# EasyEDA Pro project 第十五届蓝桥杯EDA赛项模拟试题二（嘉立创EDA提供）.eprj, board PCB-PockerMultimater1 (continued)
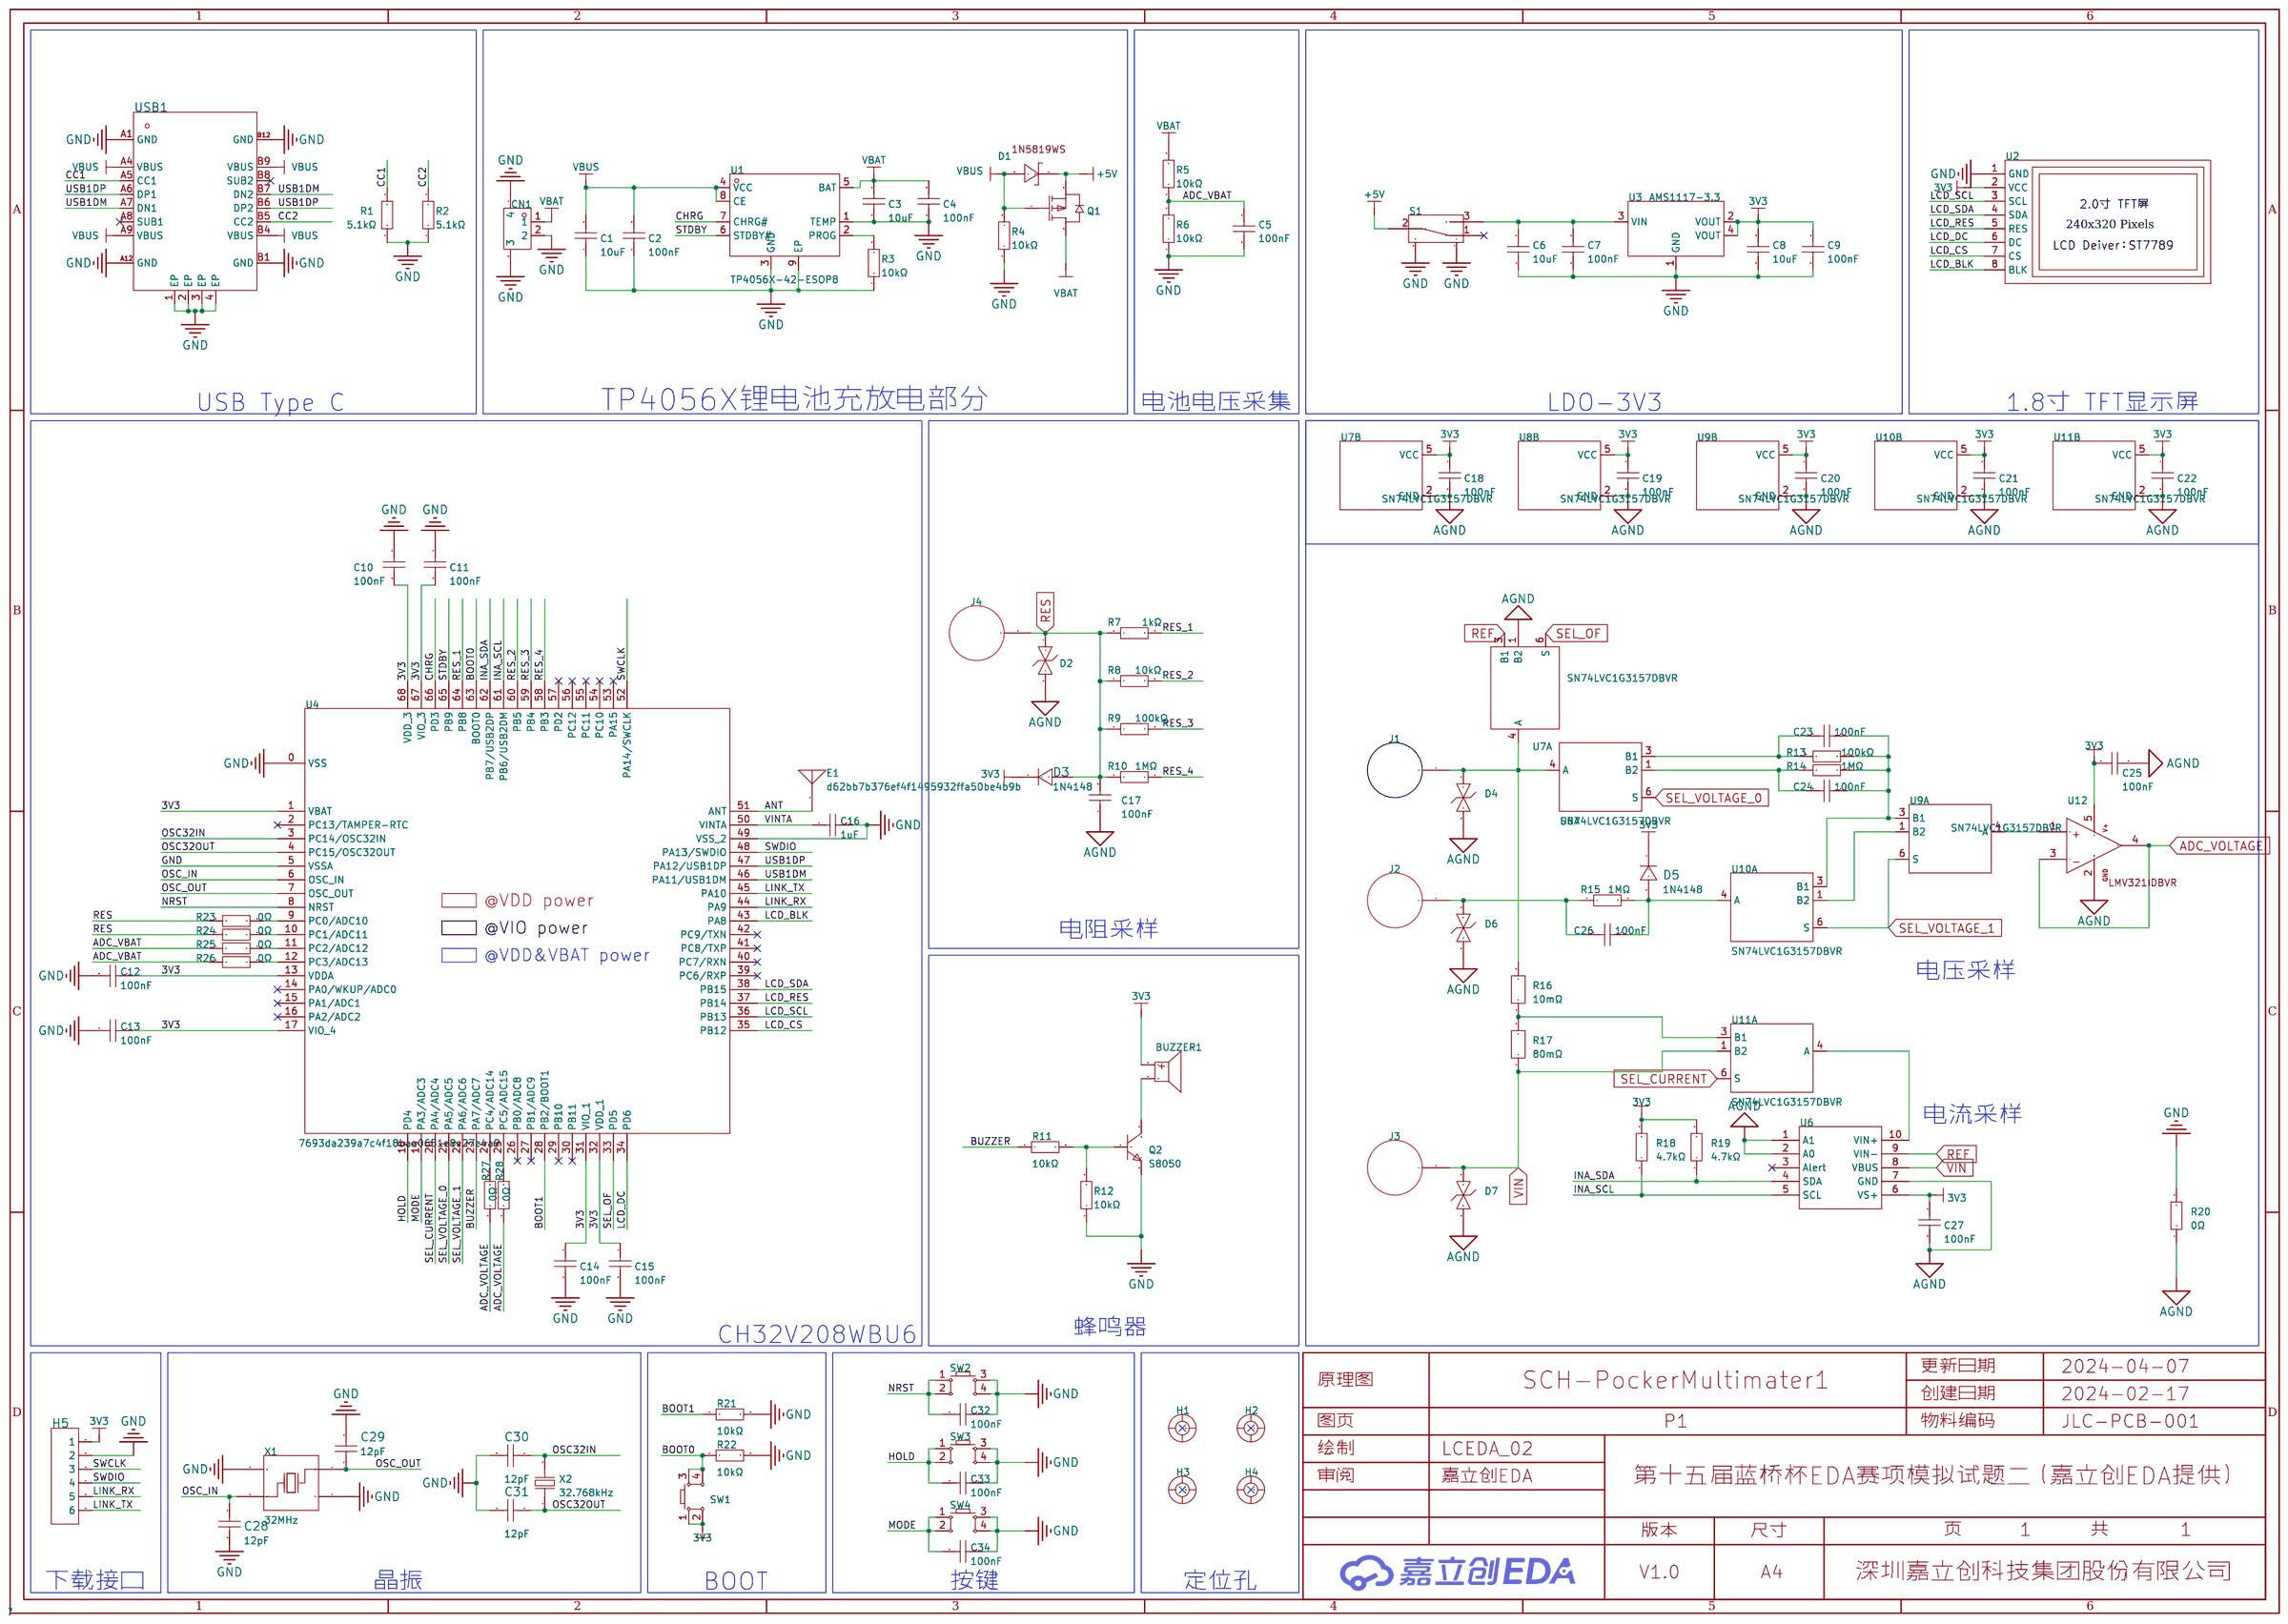
[diagram p0: schematic sheet]
## Routing (per net, layer and track width the routed paths; a pad name or vN(x,y) marks a point on that pad's centre or on a via; arc(x,y) is an arc through that point) (continued)
GND: length 169.9
  Top Layer w0.152: C1.1 C2.1 15.19,27.25 ; 15.19,27.25 v1(16.13,27.25) ; 15.19,27.25 R4.1
  Top Layer w0.254: v1(11.58,16.38) 11.58,16.39 R2.1 ; 21.25,74.35 21.26,74.37 X1.2 ; 21.25,74.35 v1(20.66,74.35) v1(18.88,74.35) 18.19,74.35 17.86,74.68 v1(17.86,76.85) v1(17.86,78.64) 18.28,79.06 v1(19.2,79.06) ; 21.25,74.35 v1(21.99,74.35) 23.25,74.35 C29.1 24.09,74.53 24.36,74.8 24.36,76.1 24.54,76.28 v1(25.66,76.28) v1(28.52,76.28) ; 37.59,66.84 37.51,66.76 36.78,66.76 ; 37.59,66.84 C14.2 36.78,66.76 ; 37.59,66.84 C15.2 38.48,65.81 v1(38.51,65.79) ; U4.0 U4.0 37.4,78.4 U4.49 ; R22.2 19.27,96.44 v1(18.8,95.96) ; 36.78,66.76 36.78,65.79 v1(36.8,65.76) ; 36.78,66.76 R21.2 35.2,66.73 v1(35.2,65.73) ; v1(19.2,79.06) 19.2,77.77 X1.4 ; v1(19.2,79.06) v1(20.67,79.06) v1(21.99,79.06) C28.2 24.88,79.06 v1(24.99,79.18) ; 41.1,79.17 41.45,79.17 v1(41.67,79.39) v1(42.29,80.01) v1(42.99,80.7) v1(43.6,81.32) v1(44.32,82.04) v1(44.86,82.58) v1(45.6,83.32) v1(46.16,83.88) v1(46.93,84.65) v1(47.53,85.25) v1(48.38,86.1) v1(49.04,86.76) v1(49.73,87.45) v1(50.47,88.19) v1(51.25,88.96) v1(51.85,89.56) v1(52.57,90.28) v1(53.26,90.98) v1(53.9,91.62) v1(55.17,91.62) v1(56.05,91.62) v1(57.1,91.62) v1(57.67,92.19) 58.66,93.18 58.66,94.03 ; v1(7.92,29.95) 7.95,29.97 7.95,31.18 9.64,31.18 9.69,31.13 ; 30.1,78.94 v1(28.06,78.94) 26.87,78.94 v1(26.59,79.22) v1(26.59,81.2) 26.59,83.01 v1(26.57,83.03) v1(26.57,84.53) v1(25.73,85.37) 24.87,85.37 24.66,85.57 v1(24.66,85.8) 24.32,86.15 C30.2 23.48,86.13 20.73,86.13 20.32,85.72 20.32,81.2 20.74,80.78 C31.2 v1(24.7,80.78) 24.99,80.49 v1(24.99,79.18) ; v1(24.99,79.18) v1(24.99,77.93) 25.32,77.6 U4.5 ; 38.99,79.83 v1(39.27,79.83) v1(40.06,79.83) 40.36,79.83 v1(40.69,80.16) v1(41.27,80.74) v1(41.92,81.39) v1(42.43,81.91) v1(42.99,82.46) v1(43.56,83.03) v1(44.19,83.66) v1(44.81,84.28) v1(45.47,84.95) v1(46.22,85.69) v1(46.89,86.36) v1(47.6,87.07) v1(48.37,87.84) v1(49.04,88.51) v1(49.83,89.3) v1(50.57,90.04) v1(51.22,90.7) v1(52.07,91.54) v1(52.88,92.35) 53.34,92.81 v1(54.06,92.81) v1(55.42,92.81) 56.19,92.81 v1(56.44,93.07) v1(56.44,94.06) ; v1(11.56,19.48) 11.56,20.22 R1.1 ; C12.2 v1(27.69,70.56)
  Top Layer w0.508: v1(1.24,33.76) 1.93,33.07 CN1.4 ; 63.24,28.42 61.88,28.42 v1(61.85,28.45) ; CN1.3 1.93,25.23 v1(1.91,25.2) ; v1(14.55,39.55) 14.56,39.55 C8.1 ; C9.2 18.71,39.53 v1(18.72,39.52) ; C6.1 6.96,52.15 v1(6.99,52.18) ; SW2.3 58.28,48.86 v1(58.25,48.89) ; 67.95,48.86 69.31,48.86 v1(69.34,48.83) ; 18.53,26.62 17.17,26.62 v1(17.14,26.65) ; R6.1 15.59,35.13 v1(15.62,35.1) ; v1(15.57,36.84) 15.54,36.87 C5.2 ; v1(20.17,28.42) 20.16,28.44 19.2,28.44 ; U1.1 17.44,27.35 v1(17.41,27.32) ; 61.12,38.56 62.49,38.56 v1(62.52,38.53) ; U3.1 14.71,46.91 v1(14.74,46.88) ; v1(18.83,31.23) 18.8,31.26 U1.3 ; v1(8.76,52.11) 8.73,52.08 8.73,50.72 ; v1(8.36,29.06) 7.99,28.69 5.76,28.69 ; 7.5,15.8 8.86,15.8 v1(8.89,15.77) ; SW3.4 69.37,40.47 v1(69.4,40.44) ; 59.6,40.47 58.24,40.47 v1(58.21,40.5) ; v1(67.98,30.75) 68,30.78 SW4.4 ; v1(66.23,28.08) 66.2,28.11 64.84,28.11 ; v1(58.21,32.17) 58.24,32.14 59.6,32.14
  Bottom Layer w0.254: v1(38.51,65.79) 38.48,65.79
  vias: v1(1.27,58.45) v1(1.3,57.45) v1(2.09,58.45) v1(2.11,57.45) v1(2.95,57.45) v1(2.99,58.45) v1(3.81,58.45) v1(3.94,57.45) v1(4.93,83.64) v1(4.9,68.43) v1(4.93,67.44) v1(4.9,64.47) v1(4.93,63.47) v1(4.95,82.65) v1(5,77.8) v1(5.03,76.81) v1(5.03,73.03) v1(5.05,72.03) v1(5.21,86.84) v1(5.23,85.85) v1(5.73,68.43) v1(5.75,67.44) v1(5.73,64.47) v1(5.75,63.47) v1(5.75,83.64) v1(5.77,82.65) v1(5.83,77.8) v1(5.85,76.81) v1(5.85,73.03) v1(5.87,72.03) v1(6.03,86.84) v1(6.05,85.85) v1(6.64,83.64) v1(6.61,82.65) v1(6.62,68.43) v1(6.58,67.44) v1(6.62,64.47) v1(6.58,63.47) v1(6.72,77.8) v1(6.68,76.81) v1(6.75,73.03) v1(6.71,72.03) v1(6.92,86.84) v1(6.89,85.85) v1(7.44,68.43) v1(7.44,64.47) v1(7.47,83.64) v1(7.55,77.8) v1(7.6,82.65) v1(7.57,73.03) v1(7.58,67.44) v1(7.58,63.47) v1(7.75,86.84) v1(7.68,76.81) v1(7.7,72.03) v1(7.88,85.85) v1(9.58,58.78) v1(9.6,57.78) v1(10.4,58.78) v1(10.42,57.78) v1(11.29,58.78) v1(11.25,57.78) v1(11.89,51.71) v1(11.91,50.72) v1(12.12,58.78) v1(12.25,57.78) v1(12.71,51.71) v1(12.73,50.72) v1(13.6,51.71) v1(13.57,50.72) v1(14.43,51.71) v1(14.56,50.72) v1(17.25,85.09) v1(17.25,84.27) v1(17.25,83.38) v1(17.25,82.55) v1(17.86,74.93) v1(18.24,85.22) v1(18.24,84.23) v1(18.24,83.39) v1(18.24,82.58) v1(23.39,93.93) v1(23.42,92.94) v1(24.08,60.57) v1(24.05,57.84) v1(24.22,93.93) v1(24.24,92.94) v1(25.11,93.93) v1(25.07,92.94) v1(25.94,93.93) v1(26.07,92.94) v1(28.7,86.28) v1(28.73,85.29) v1(29.53,86.28) v1(29.55,85.29) v1(30.42,86.28) v1(30.38,85.29) v1(31.24,86.28) v1(31.37,85.29) v1(33.83,93) v1(33.86,92.01) v1(34.66,93) v1(34.68,92.01) v1(35.55,93) v1(35.51,92.01) v1(35.48,63.63) v1(35.51,62.64) v1(36.31,63.63) v1(36.33,62.64) v1(36.37,93) v1(36.5,92.01) v1(37.2,63.63) v1(37.16,62.64) v1(38.03,63.63) v1(38.16,62.64) v1(39.85,83.64) v1(39.88,82.65) v1(40.03,98.37) v1(40.06,97.38) v1(40.26,96.32) v1(40.28,95.33) v1(40.31,85.8) v1(40.34,84.81) v1(40.39,94.06) v1(40.41,93.07) v1(40.68,83.64) v1(40.7,82.65) v1(40.86,98.37) v1(40.87,97.38) v1(40.87,92.08) v1(40.89,91.08) v1(40.87,88.32) v1(40.89,87.33) v1(41.08,96.32) v1(41.1,95.33) v1(41.13,85.8) v1(41.21,94.06) v1(41.23,93.07) v1(41.15,84.81) v1(41.28,90.3) v1(41.3,89.31) v1(41.53,82.65) v1(41.57,83.64) v1(41.75,98.37) v1(41.71,97.38) v1(41.69,92.08) v1(41.71,91.08) v1(41.69,88.32) v1(41.71,87.33) v1(41.94,95.33) v1(41.97,96.32) v1(42.03,85.8) v1(41.99,84.81) v1(42.1,94.06) v1(42.06,93.07) v1(42.1,90.3) v1(42.12,89.31) v1(42.39,83.64) v1(42.55,91.08) v1(42.55,87.33) v1(42.53,82.65) v1(42.57,98.37) v1(42.58,92.08) v1(42.58,88.32) v1(42.7,97.38) v1(42.8,96.32) v1(42.93,95.33) v1(42.93,94.06) v1(42.85,85.8) v1(42.99,90.3) v1(42.95,89.31) v1(42.98,84.81) v1(43.06,93.07) v1(43.33,61.72) v1(43.41,92.08) v1(43.41,88.32) v1(43.36,60.73) v1(43.54,91.08) v1(43.54,87.33) v1(43.64,67.87) v1(43.66,66.88) v1(43.82,90.3) v1(43.95,89.31) v1(44.16,61.72) v1(44.18,60.73) v1(44.27,64.87) v1(44.3,63.88) v1(44.46,67.87) v1(44.48,66.88) v1(44.73,92.1) v1(44.75,91.11) v1(45.03,88.95) v1(45.05,61.72) v1(45.01,60.73) v1(45.06,87.96) v1(45.1,64.87) v1(45.12,63.88) v1(45.32,66.88) v1(45.35,67.87) v1(45.55,92.1) v1(45.57,91.11) v1(45.86,88.95) v1(45.88,87.96) v1(45.87,61.72) v1(45.99,64.87) v1(45.95,63.88) v1(46,60.73) v1(46.18,67.87) v1(46.31,66.88) v1(46.45,92.1) v1(46.41,91.11) v1(46.58,83.19) v1(46.71,87.96) v1(46.71,82.19) v1(46.75,88.95) v1(46.81,64.87) v1(46.94,63.88) v1(47.12,78.75) v1(47.12,76.17) v1(47.27,92.1) v1(47.4,91.11) v1(47.53,82.19) v1(47.58,88.95) v1(47.57,83.19) v1(47.71,87.96) v1(48.34,85.04) v1(48.36,92.35) v1(48.39,91.36) v1(48.36,84.05) v1(48.41,83.19) v1(48.43,82.19) v1(49.19,92.35) v1(49.21,91.36) v1(49.16,85.04) v1(49.18,84.05) v1(49.22,83.19) v1(49.25,82.19) v1(50.04,91.36) v1(50.01,84.05) v1(50.08,92.35) v1(50.05,85.04) v1(50.57,87) v1(50.6,86) v1(50.9,92.35) v1(50.88,85.04) v1(51.03,91.36) v1(51.01,84.05) v1(51.08,79.88) v1(51.1,78.89) v1(51.4,87) v1(51.42,86) v1(51.46,69.72) v1(51.49,68.73) v1(51.9,79.88) v1(51.92,78.89) v1(52.25,86) v1(52.2,66.65) v1(52.22,65.66) v1(52.29,87) v1(52.29,69.72) v1(52.3,68.73) v1(52.58,89) v1(52.6,88.01) v1(52.8,79.88) v1(52.76,78.89) v1(52.76,63.19) v1(52.78,62.2) v1(52.86,84.76) v1(52.88,83.77) v1(53.02,66.65) v1(53.04,65.66) v1(53.11,87) v1(53.14,68.73) v1(53.24,86) v1(53.18,69.72) v1(53.4,89) v1(53.42,88.01) v1(53.62,79.88) v1(53.58,63.19) v1(53.6,62.2) v1(53.68,84.76) v1(53.7,83.77) v1(53.75,78.89) v1(53.91,66.65) v1(53.88,65.66) v1(54,69.72) v1(54.13,68.73) v1(54.29,89) v1(54.26,88.01) v1(54.43,62.2) v1(54.54,83.77) v1(54.47,63.19) v1(54.56,90.88) v1(54.58,89.89) v1(54.57,84.76) v1(54.74,66.65) v1(54.91,86.77) v1(54.94,85.78) v1(54.87,65.66) v1(55.12,89) v1(55.25,88.01) v1(55.3,63.19) v1(55.38,90.88) v1(55.4,89.89) v1(55.4,84.76) v1(55.43,62.2) v1(55.53,83.77) v1(55.74,86.77) v1(55.76,85.78) v1(56.13,79.63) v1(56.24,89.89) v1(56.16,78.64) v1(56.28,90.88) v1(56.57,88.24) v1(56.59,87.25) v1(56.63,86.77) v1(56.59,85.78) v1(56.59,83.74) v1(56.62,82.75) v1(56.96,79.63) v1(56.98,78.64) v1(57.1,90.88) v1(57.23,89.89) v1(57.39,88.24) v1(57.41,87.25) v1(57.42,83.74) v1(57.44,82.75) v1(57.46,86.77) v1(57.59,85.78) v1(57.85,79.63) v1(57.81,78.64) v1(57.84,61.19) v1(57.86,60.2) v1(58.24,87.25) v1(58.29,90.07) v1(58.32,89.08) v1(58.28,88.24) v1(58.31,83.74) v1(58.27,82.75) v1(58.68,79.63) v1(58.66,61.19) v1(58.68,60.2) v1(58.75,92.1) v1(58.78,91.11) v1(58.81,78.64) v1(59.12,90.07) v1(59.14,89.08) v1(59.11,88.24) v1(59.13,83.74) v1(59.24,87.25) v1(59.26,82.75) v1(59.51,60.2) v1(59.58,92.1) v1(59.59,91.11) v1(59.55,61.19) v1(60.01,90.07) v1(59.97,89.08) v1(60.43,91.11) v1(60.38,61.19) v1(60.47,92.1) v1(60.51,60.2) v1(60.83,90.07) v1(60.97,89.08) v1(61.29,92.1) v1(61.42,91.11) v1(61.65,87.25) v1(61.67,86.26) v1(62.47,87.25) v1(62.49,86.26) v1(63.32,86.26) v1(63.36,87.25) v1(64.19,87.25) v1(64.32,86.26) v1(67.54,71.35) v1(67.54,70.52) v1(67.54,69.63) v1(67.54,68.81) v1(67.64,62.26) v1(67.64,61.43) v1(67.64,60.54) v1(67.64,59.72) v1(67.69,88.62) v1(67.69,87.8) v1(67.69,86.91) v1(67.69,86.08) v1(67.82,79.2) v1(67.82,78.37) v1(67.82,77.48) v1(67.82,76.66) v1(68.53,71.48) v1(68.53,70.49) v1(68.53,69.65) v1(68.53,68.83) v1(68.63,62.39) v1(68.63,61.39) v1(68.63,60.56) v1(68.63,59.74) v1(68.68,88.75) v1(68.68,87.76) v1(68.68,86.92) v1(68.68,86.11) v1(68.81,79.33) v1(68.81,78.34) v1(68.81,77.5) v1(68.81,76.68)
VBAT: length 4.1
  Top Layer w0.508: R5.2 8.38,35.13 7.92,34.67 7.92,32.6 7.95,32.58
  vias: v1(4.6,32.84) v1(4.58,31.94) v1(5.45,32.84) v1(5.51,31.94) v1(6.42,32.84) v1(6.42,31.94) v1(17.25,23.8) v1(17.22,23) v1(17.22,22.1) v1(18.12,23.8) v1(18.12,23) v1(18.12,22.1)
VBUS:
  vias: v1(11.07,27.89) v1(11.07,27.11) v1(11.07,26.2) v1(17.04,33.3) v1(17.84,33.3) v1(18.66,33.3)
VIN: length 35.6
  Top Layer w0.203: U6.8 49.02,30.33 48.75,30.06 U11.1
  Top Layer w0.508: R17.1 v1(41.94,26.72) v1(41.94,27.44) v1(41.94,28.1) 41.94,28.63 42.47,29.16 45.52,29.16 46.38,30.02 47.71,30.02 U11.1 ; J3.1 42.33,14.83 D7.1 42.29,14.9 v1(42.29,16.78) v1(42.29,17.53)
  Bottom Layer w0.508: v1(42.32,16.03) 42.29,16.05 v1(42.29,16.78) v1(42.29,17.53) 42.29,17.83 41.94,18.19 v1(41.94,26.72) v1(41.94,27.44) v1(41.94,28.1)
VINTA: length 4.1
  Top Layer w0.152: 43.12,78.79 43.11,78.8 U4.50
ADC_VBAT: length 71.3
  Top Layer w0.152: C5.1 12.77,38.22 12.98,38.43 v1(19.25,38.43) ; R26.1 R25.1 16.56,69.77 16.36,69.57 16.36,67.74 17.78,66.32 26.49,66.32 29.46,63.34 29.46,50.65 30.2,49.91 v1(30.4,49.91)
  Top Layer w0.508: R5.1 R6.2 12.77,35.18 C5.1
  Bottom Layer w0.152: v1(30.4,49.91) 30.07,49.58 20.16,49.58 19.25,48.68 v1(19.25,38.43)
ADC_VOLTAGE: length 49.6
  Top Layer w0.152: U12.3 v1(36.72,38.58) ; R28.1 R27.1 32.66,66.95 32.28,66.57 32.28,55.32 32.72,54.89 v1(35.53,54.89) ; v1(35.61,34.04) 36.69,34.04 U12.4
  Bottom Layer w0.152: v1(35.61,34.04) 35.61,38.2 35.97,38.56 36.69,38.56 v1(36.72,38.58) 37.18,39.04 40.06,39.04 40.39,39.37 40.39,54.56 40.06,54.89 v1(35.53,54.89)
ANT: length 25.2
  Top Layer w0.152: U4.51 40.59,79.2 53.62,92.23 56.87,92.23 57.18,92.53 57.18,94.03
BOOT0: length 45.1
  Top Layer w0.152: v1(16.81,97.13) 16.82,97.14 SW1.3 ; R22.1 18.85,98.72 SW1.3 ; SW1.4 SW1.3 ; v1(19.46,89.69) 19.53,89.61 31.71,89.61 33.8,87.52 U4.63
  Bottom Layer w0.152: v1(16.81,97.13) 17.14,96.8 19.18,96.8 19.46,96.52 v1(19.46,89.69)
BOOT1: length 4
  Top Layer w0.152: R21.1 35.18,69.55 35.8,70.17 U4.28
BUZZER: length 69
  Top Layer w0.152: R11.1 58.83,29.97 56.24,32.56 56.24,51.89 55.52,52.6 37.14,52.6 36.75,52.99 36.75,53.92 36.45,54.23 32.31,54.23 31.88,54.66 31.88,69.06 32.54,69.72 33.32,69.72 33.8,70.2 U4.23
CC1: length 2.5
  Top Layer w0.152: USB1.A5 9.98,20.25 10,20.27
CC2: length 2.6
  Top Layer w0.152: R2.2 10.04,17.25 USB1.B5
CHRG: length 109
  Top Layer w0.152: v1(11.07,29.99) 11.08,29.99 U1.7 ; U4.66 32.6,87.15 31.37,88.38 16.3,88.38 15.28,87.36 15.28,67.31 17.5,65.09 26.43,65.09 28.23,63.28 28.23,48.02 v1(28.19,47.98)
  Bottom Layer w0.152: 11.07,29.97 v1(11.07,29.99) 12.31,29.99 16.51,34.19 19.96,34.19 20.29,34.52 20.29,47.52 20.76,47.98 v1(28.19,47.98)
HOLD: length 72.1
  Top Layer w0.152: SW3.2 67.98,44.99 59.62,44.99 ; 59.62,44.99 59.6,44.97 ; 59.62,44.99 C33.2 57.25,46.91 56.87,47.3 56.87,53.67 56.49,54.05 37.87,54.05 37.67,54.25 v1(37.16,54.25) ; U4.18 31.8,71.65 29.87,69.72 29.87,51.16 30.35,50.67 v1(32.89,50.67)
  Bottom Layer w0.152: v1(37.16,54.25) 33.27,54.25 32.92,53.9 32.92,50.7 v1(32.89,50.67)
INA_SCL: length 124.9
  Top Layer w0.152: U4.61 34.6,87.88 31.81,90.67 15.35,90.67 12.99,88.31 12.99,66.36 15.84,63.51 25.49,63.51 26.68,62.32 26.68,51.39 26.44,51.16 24.94,51.16 24.61,50.83 24.61,47.35 25.07,46.89 47.87,46.89 48.02,46.74 U6.5 48.02,35.49 48.31,35.2 50.19,35.2 51,34.39 R18.1
INA_SDA: length 122
  Top Layer w0.152: U4.62 34.2,87.71 31.64,90.27 15.51,90.27 13.39,88.14 13.39,66.53 16.01,63.91 25.65,63.91 27.08,62.48 27.08,51.13 26.77,50.83 25.37,50.83 25.12,50.57 25.12,47.55 25.35,47.32 48.37,47.32 48.52,47.17 U6.4 48.52,36.21 48.87,35.86 R19.1
LCD_BLK: length 34.9
  Top Layer w0.152: U4.43 39.6,76 40.26,75.34 v1(60.4,75.34)
  Bottom Layer w0.152: v1(60.4,75.34) 60.4,66.42 60.71,66.12 64.59,66.12 64.6,66.11
LCD_CS: length 29
  Top Layer w0.152: v1(61.77,71.96) 60.93,72.8 U4.35
  Bottom Layer w0.152: v1(61.77,71.96) 61.77,69.24 62.41,68.61 64.56,68.61 64.6,68.65
LCD_DC: length 27.1
  Top Layer w0.152: 64.6,71.19 64.56,71.15 38.43,71.15 38.2,71.38 U4.34
LCD_RES: length 25.7
  Top Layer w0.152: U4.37 64.47,73.6 64.6,73.73
LCD_SCL: length 31.5
  Top Layer w0.152: U4.36 61.9,73.2 v1(62.31,72.8)
  Bottom Layer w0.152: 64.6,78.81 64.5,78.71 62.76,78.71 62.31,78.26 v1(62.31,72.8)
LCD_SDA: length 26.6
  Top Layer w0.152: 64.6,76.27 62.33,74 U4.38
LINK_RX: length 36.6
  Top Layer w0.152: 42.85,76.4 42.85,76.4 ; 42.85,76.4 43.06,76.4 v1(43.49,75.97) ; 42.85,76.4 U4.44
  Bottom Layer w0.152: H5.5 31.88,94.87 32.31,94.44 36.42,94.44 37.34,93.52 37.34,77.6 38.53,76.4 43.05,76.4 v1(43.49,75.97)
LINK_TX: length 36.4
  Top Layer w0.152: U4.45 43.77,76.8 v1(44.55,76.02)
  Bottom Layer w0.152: v1(44.55,76.02) 43.76,76.81 38.79,76.81 37.77,77.83 37.77,94.26 37.03,95 34.67,95 34.39,95.28 34.39,98.02 H5.6
MODE: length 77
  Top Layer w0.152: v1(34.59,51.36) 30.86,51.36 30.28,51.94 30.28,69.6 31.78,71.09 32.08,71.09 32.2,71.21 U4.19 ; 59.62,36.66 59.6,36.64 ; 59.62,36.66 67.98,36.66 SW4.2 ; 59.62,36.66 C34.2 57.02,38.56 56.57,39.01 56.57,52.68 55.85,53.39 v1(37.57,53.39)
  Bottom Layer w0.152: v1(34.59,51.36) 34.57,51.38 34.57,53.14 34.82,53.39 v1(37.57,53.39)
NRST: length 101.2
  Top Layer w0.152: U4.8 29.49,76.4 28.8,75.72 25.37,75.72 25.04,75.39 25.04,74.17 24.54,73.66 15.82,73.66 15.65,73.48 15.65,67.41 17.53,65.53 26.41,65.53 28.68,63.27 28.68,49.15 29.57,48.26 v1(41.15,48.26) ; v1(41.12,55.4) 59.6,55.4 C32.2 59.65,53.37 ; 59.65,53.37 SW2.1 ; 59.65,53.37 59.66,53.36 SW2.2
  Bottom Layer w0.152: v1(41.12,55.4) 41.15,55.37 v1(41.15,48.26)
OSC32IN: length 15.1
  Top Layer w0.152: U4.3 31,78.38 26.47,78.38 25.98,78.87 25.98,83.97 25.21,84.75 C30.1 23.49,84.74 X2.2
OSC32OUT: length 13.1
  Top Layer w0.152: 31.03,78.02 U4.4 26.29,78 25.58,78.71 25.58,81.97 25.35,82.19 23.46,82.19 C31.1 23.39,82.24 X2.1
OSC_IN: length 10
  Top Layer w0.152: 31.03,77.22 U4.6 23.93,77.2 23.47,77.66 23.45,77.64 X1.3
OSC_OUT: length 13.1
  Top Layer w0.152: X1.1 19.96,76.78 22.59,76.78 C29.2 24.31,76.8 U4.7 31.03,76.82
REF: length 33.1
  Top Layer w0.152: v1(25.5,30.18) 25.49,30.16 U7.3 ; U6.9 v1(49.52,34.59)
  Bottom Layer w0.152: v1(25.5,30.18) 25.5,29.18 25.76,28.93 49.02,28.93 49.53,29.44 49.53,34.59 v1(49.52,34.59)
RES: length 123.4
  Top Layer w0.152: 54.46,31.78 57.1,29.14 57.1,24.59 56.47,23.95 51.21,23.95 49.33,22.07 49.33,17.98 49.47,17.84 R7.1 ; R24.1 R23.1 16.54,72.24 15.95,71.65 15.95,67.56 17.6,65.91 26.46,65.91 29.06,63.32 29.06,50.14 30,49.2 53.65,49.2 54.43,48.41 54.43,31.78 ; 55.01,17.84 R10.1
  Top Layer w0.508: D3.2 56.71,15.41 D2.1 56.78,8.22 J4.1 ; D3.2 58.44,17.84 C17.2 ; D3.2 R7.1
RES_1: length 154.4
  Top Layer w0.152: v1(51.94,51.94) 54.86,49.02 54.86,31.95 57.51,29.31 57.51,24.56 56.59,23.65 51.64,23.65 50.35,22.36 R7.2 ; U4.64 33.4,87.49 31.71,89.18 15.97,89.18 14.48,87.69 14.48,66.98 17.17,64.29 26.37,64.29 27.43,63.22 27.43,50.57 27.18,50.32 v1(26.44,50.32)
  Bottom Layer w0.152: v1(51.94,51.94) 51.94,56.64 51.46,57.12 26.92,57.12 26.44,56.64 v1(26.44,50.32)
RES_2: length 150.1
  Top Layer w0.152: U4.60 35,88.04 31.97,91.07 15.18,91.07 12.59,88.47 12.59,66.2 15.68,63.11 25.32,63.11 26.28,62.15 26.28,57.26 v1(25.22,56.21) ; v1(52.81,51.94) 55.22,49.53 55.22,32.1 57.86,29.45 57.86,24.49 56.69,23.32 52.35,23.32 51.93,22.89 R8.2
  Bottom Layer w0.152: v1(52.81,51.94) 52.81,57.2 52.38,57.63 26.64,57.63 v1(25.22,56.21)
RES_3: length 149.6
  Top Layer w0.152: R9.2 53.48,22.51 53.97,23.01 56.82,23.01 58.19,24.38 58.19,29.59 55.55,32.23 55.55,50.11 v1(53.75,51.92) ; v1(25.22,57.3) 25.88,57.96 25.88,61.99 25.16,62.71 15.51,62.71 12.19,66.03 12.19,88.64 15.02,91.47 32.14,91.47 35.4,88.21 U4.59
  Bottom Layer w0.152: v1(25.22,57.3) 26.01,58.09 53.19,58.09 53.75,57.53 v1(53.75,51.92)
RES_4: length 149.7
  Top Layer w0.152: U4.58 35.8,88.38 32.3,91.87 14.85,91.87 11.79,88.81 11.79,65.86 15.34,62.31 24.99,62.31 25.48,61.82 25.48,58.57 v1(25.17,58.27) ; v1(54.79,51.94) 55.88,50.85 55.88,32.41 58.55,29.74 58.55,24.31 56.94,22.71 55.45,22.71 55.03,22.28 R10.2
  Bottom Layer w0.152: v1(54.79,51.94) 54.79,58.11 54.28,58.62 25.53,58.62 v1(25.17,58.27)
SEL_CURRENT: length 63.9
  Top Layer w0.152: v1(41.81,51.99) 41.78,51.97 31.29,51.97 30.66,52.6 30.66,69.44 31.98,70.76 32.36,70.76 32.6,71 U4.20 ; v1(51.46,33.43) 51.46,30.33 51.49,30.3 51.24,30.06 U11.6
  Bottom Layer w0.152: v1(51.46,33.43) 51.46,51.33 50.8,51.99 v1(41.81,51.99)
SEL_OF: length 59.1
  Top Layer w0.152: v1(33.07,56.24) 39.9,56.24 40.54,56.87 40.54,68.78 40.13,69.19 38.46,69.19 37.8,69.84 U4.33 ; v1(29.77,37.26) 29.46,36.96 29.46,26.49 29.33,26.36 U7.6
  Bottom Layer w0.152: v1(29.77,37.26) 29.77,39.14 31.39,40.77 31.39,55.88 31.75,56.24 v1(33.07,56.24)
SEL_VOLTAGE_0: length 42.7
  Top Layer w0.152: U8.6 28.93,34.03 29.03,34.14 29.03,37.59 v1(30.4,38.96) ; U4.21 33,70.64 32.77,70.41 32.16,70.41 31.01,69.27 31.01,53.49 31.78,52.73 v1(32.03,52.73)
  Bottom Layer w0.152: v1(32.03,52.73) 32.06,52.7 32.16,52.7 32,52.55 32,40.56 v1(30.4,38.96)
SEL_VOLTAGE_1: length 54
  Top Layer w0.152: U10.6 v1(39.65,41.6) ; v1(35.92,52.78) 32.84,52.78 31.47,54.15 31.47,69.16 32.36,70.05 33.15,70.05 33.4,70.31 U4.22 ; U9.6 v1(33.76,34.06)
  Bottom Layer w0.152: v1(33.76,34.06) 33.76,41.17 34.19,41.6 v1(39.65,41.6) 39.65,52.55 39.4,52.81 35.94,52.81 v1(35.92,52.78)
STDBY: length 109
  Top Layer w0.152: U4.65 33,87.32 31.54,88.78 16.13,88.78 14.88,87.52 14.88,67.15 17.34,64.69 26.4,64.69 27.83,63.25 27.83,49.35 27.46,48.97 v1(27.36,48.97) ; U1.6 11.05,31.26 v1(11.05,31.26)
  Bottom Layer w0.152: v1(11.05,31.26) 12.79,31.26 16.23,34.7 19.63,34.7 19.79,34.85 19.79,48.25 20.51,48.97 v1(27.36,48.97)
SWCLK: length 28.8
  Top Layer w0.152: U4.52 38.2,93.7 37.72,94.18 27.36,94.18 26.77,94.77 26.77,98.02 H5.3
SWDIO: length 35.6
  Top Layer w0.152: U4.48 41.09,78 v1(41.38,78.28)
  Bottom Layer w0.152: 29.34,98.04 30.56,99.26 37.87,99.26 38.2,98.93 38.2,78.69 38.61,78.28 v1(41.38,78.28)
USB1DM: length 112.8
  Top Layer w0.152: USB1.B7 8.31,19.75 8.46,19.6 8.46,18.85 8.36,18.75 ; USB1.A7 7.5,18.75 8.36,18.75 ; v1(24.08,59.61) 23.77,59.31 23.14,59.31 22.17,58.34 22.17,19.41 21.42,18.65 20.6,18.65 20.45,18.8 20.45,19.02 20.29,19.18 19.08,19.18 18.92,19.02 18.92,18.8 18.77,18.65 17.55,18.65 17.4,18.8 17.4,19.02 17.25,19.18 16.03,19.18 15.88,19.02 15.88,18.8 15.72,18.65 14.5,18.65 14.35,18.8 14.35,19.02 14.2,19.18 12.98,19.18 12.83,19.02 12.83,18.8 12.67,18.65 9.24,18.65 9.14,18.75 8.36,18.75 ; v1(47.12,77.01) 46.88,77.25 39.51,77.25 39.46,77.2 U4.46
  Bottom Layer w0.152: v1(24.08,59.61) 24.44,59.61 24.71,59.33 48.31,59.33 48.72,59.74 48.72,77.11 48.54,77.29 47.42,77.29 47.14,77.01 v1(47.12,77.01)
USB1DP: length 112.7
  Top Layer w0.152: U4.47 39.46,77.6 39.51,77.55 46.77,77.55 v1(47.12,77.9) ; v1(24.05,58.75) 23.8,59 23.27,59 22.48,58.22 22.48,19.28 21.54,18.34 9.24,18.34 9.14,18.25 USB1.B6 6.62,18.25 6.48,18.39 6.48,19.13 6.6,19.25 7.49,19.25 USB1.A6
  Bottom Layer w0.152: v1(47.12,77.9) 47.42,77.6 48.67,77.6 49.02,77.24 49.02,59.61 48.44,59.03 24.71,59.03 24.44,58.75 v1(24.05,58.75)
$1N2724: length 1.8
  Top Layer w0.152: 17.43,29.99 R3.2
$1N6482: length 10
  Top Layer w0.152: U9.4 30.95,35.07 31.14,35.25 38.41,35.25 38.63,35.48 38.63,36.59 U12.1
$1N6484: length 19.7
  Top Layer w0.508: R16.1 41.81,19.11 41.94,19.24 45.4,19.24 45.95,19.79 45.95,27.48 46.58,28.12 47.71,28.12 U11.3
$1N6487: length 53.2
  Top Layer w0.508: U8.4 25.47,31.56 24.46,30.56 24.46,28.27 25.45,27.28 25.45,26.4 U7.4 25.48,26.35 v1(25.48,23.11) 25.48,22.44 v1(25.49,22.42) 25.48,22.41 v1(25.48,21.74) 25.48,16.51 24.94,15.98 18.03,15.98 17.34,15.28 D4.1 17.34,12.34 J1.1 ; R16.2 36.21,25.3 v1(34.09,25.3) v1(33.31,25.3) v1(32.53,25.3)
  Bottom Layer w0.152: v1(25.48,21.74) v1(25.48,23.11)
  Bottom Layer w0.508: 26.17,22.42 26.16,22.42 ; 26.17,22.42 29.31,22.42 32.18,25.3 v1(32.53,25.3) v1(33.31,25.3) v1(34.09,25.3) ; 26.17,22.42 arc(25.68,22.63) v1(25.48,23.11) ; 26.16,22.42 v1(25.49,22.42) ; 26.16,22.42 arc(25.68,22.22) v1(25.48,21.74)
$1N6488: length 47.9
  Top Layer w0.152: 30.61,14.93 D6.1 ; R15.1 42.88,41.52 C26.1
  Top Layer w0.508: C26.1 42.85,41.42 42.85,30.81 42.16,30.12 31.22,30.12 30.62,29.53 D6.1 30.62,10.96 J2.1
$1N6489: length 9.1
  Top Layer w0.152: U10.4 36.74,42.48 36.88,42.62 39.95,42.62 40.44,43.1 41.37,43.1 R15.2 41.41,43.06 C26.2 41.4,41.44 D5.2
$1N6490: length 3.8
  Top Layer w0.152: C24.1 28.68,38.75 R14.1 27.15,38 27.34,37.81 27.34,36.68
$1N6491: length 3.6
  Top Layer w0.152: 25.44,36.68 25.44,37.66 25.63,37.85 25.63,38.7 ; 25.63,38.7 24.13,38.7 ; 25.63,38.7 R13.1
$1N6508: length 19.8
  Top Layer w0.152: 30.94,40.26 35.18,40.26 35.46,40.54 35.46,43.02 35.77,43.33 36.53,43.33 36.7,43.51 36.7,44.26 U10.3 ; 30.94,40.26 28.72,40.26 ; 30.94,40.26 30.96,40.23 30.96,36.77 U9.3 ; 28.72,40.26 C24.2 ; 28.72,40.26 R14.2 25.68,40.26 R13.2 25.6,40.17 C23.2
$1N6517: length 12.6
  Top Layer w0.152: U10.1 38.66,44.29 38.66,43.15 38.51,43 36.32,43 35.87,42.55 35.87,40.23 35.43,39.8 33.12,39.8 32.85,39.53 U9.1
$1N9045: length 6.1
  Top Layer w0.203: U11.4 50.41,28.12 49.71,28.12 49.43,28.4 49.43,31.52 50.02,32.11 U6.10
$1N10212: length 10.3
  Top Layer w0.152: U4.9 29.62,76 28.98,75.36 25.65,75.36 25.37,75.08 25.37,72.95 24.66,72.24 R23.2
$1N10257: length 11.2
  Top Layer w0.152: R24.2 25.04,70.99 25.71,71.65 25.71,74.73 26.03,75.06 29.24,75.06 29.78,75.6 U4.10
$1N10302: length 12.1
  Top Layer w0.152: R25.2 25.65,69.77 26.16,70.28 26.16,74.37 26.54,74.75 29.44,74.75 29.89,75.2 U4.11
$1N10388: length 13
  Top Layer w0.152: R26.2 26.11,68.61 26.54,69.04 26.54,74.12 26.75,74.32 26.77,74.32 26.9,74.45 29.57,74.45 29.92,74.8 U4.12
$1N10482: length 4.2
  Top Layer w0.152: U4.24 34.2,70.01 32.66,68.48 R27.2
$1N10485: length 3.9
  Top Layer w0.152: U4.25 34.6,69.88 33.83,69.11 R28.2
$1N61600: length 6.6
  Top Layer w0.152: Q2.3 67.04,22.63 66.91,22.5
$1N61623: length 3.1
  Top Layer w0.152: R11.2 R12.2 64.8,29.97 64.84,30.01

## Copper pours and planes (outline as drawn; the poured copper is in the pictures)
3V3 on Top Layer: 10.44,48.16 10.54,48.26 11.61,48.26 11.61,42.78 12.02,42.37 18.23,42.37 18.41,42.19 18.41,40.52 18.34,40.44 13.62,40.44 12.78,39.6 9.3,39.6 9.09,39.8 9.09,42.09 9.5,42.49 10.08,42.49 10.44,42.85
+5V on Top Layer: 12.57,21.18 11.76,21.18 11.58,21.36 11.58,22.35 12.14,22.91 14.66,22.91 14.73,22.83 14.73,20.4 14.53,20.19 12.78,20.19 12.57,20.4
+5V on Bottom Layer: 14.53,20.19 14.73,20.4 14.73,21.62 14.28,22.07 14.25,22.07 13.39,22.94 10.54,22.94 3.71,29.77 3.71,34.19 7.31,37.8 7.31,46.79 6.5,47.6 1.37,47.6 1.04,47.27 1.04,45.06 1.32,44.78 5.21,44.78 5.51,44.48 5.51,38.96 2.06,35.71 1.93,35.59 1.93,29.54 11.25,20.22 14.5,20.22
AGND on Top Layer: 21.49,44.27 21.49,45.87 21.92,46.3 57.2,46.3 57.28,46.23 57.28,23.6 59.97,20.9 59.97,17.07 73.91,3.12 73.91,-1.4 -0.71,-1.4 -1.88,-0.23 -1.88,9.09 0.99,11.96 6.83,11.96 9.17,14.3 14.66,14.3 17.25,16.89 19.96,16.89 20.88,17.81 20.88,24.96 20.09,25.75 20.09,27.63 20.73,28.27 20.73,43.51
AGND on Bottom Layer: 21.49,44.22 21.49,45.82 21.92,46.25 57.2,46.25 57.28,46.18 57.28,23.55 59.97,20.85 59.97,17.02 73.91,3.07 73.91,-1.45 -0.71,-1.45 -1.88,-0.28 -1.88,9.04 0.99,11.91 6.83,11.91 9.17,14.25 14.66,14.25 17.25,16.84 19.96,16.84 20.88,17.75 20.88,24.91 20.09,25.7 20.09,27.58 20.73,28.22 20.73,43.46
GND on Top Layer: 6.58,12.78 8.56,14.76 13.61,14.76 16.31,17.45 18.31,17.45 19.58,18.72 19.58,27.38 20.55,28.35 20.55,46.36 20.88,46.69 48.87,46.69 49.22,46.33 49.22,42.22 49.48,41.96 54.61,41.96 54.69,41.88 54.69,32.33 57.53,29.49 57.53,24.82 60.55,21.79 60.55,17.81 69.52,8.84 73.89,8.84 73.89,105.16 72.59,106.45 -8.28,106.45 -8.28,15.65 -5.41,12.78
GND on Bottom Layer: 6.55,12.78 8.53,14.76 13.59,14.76 16.28,17.45 18.29,17.45 19.56,18.72 19.56,27.38 20.53,28.35 20.53,46.36 20.85,46.69 48.84,46.69 49.2,46.33 49.2,42.22 49.45,41.96 54.58,41.96 54.66,41.88 54.66,32.33 57.51,29.49 57.51,24.82 60.53,21.79 60.53,17.81 69.49,8.84 73.86,8.84 73.86,105.16 70.97,108.05 -6.71,108.05 -8.31,106.45 -8.31,15.65 -5.44,12.78
VBAT on Top Layer: 15.21,23.34 16.15,24.28 18.41,24.28 18.54,24.16 18.54,21.77 18.31,21.54 15.27,21.54 15.21,21.59
VBAT on Top Layer: 12.78,32.21 11.4,32.21 11.23,32.03 7.13,32.03 6.9,31.8 6.9,29.89 6.78,29.77 4.19,29.77 4.13,29.83 4.13,33.19 4.27,33.33 11.07,33.33 11.25,33.15 12.93,33.15 13.03,33.05 13.03,32.46
VBAT on Bottom Layer: 4.27,33.3 6.43,33.3 6.88,32.84 6.88,29.34 11.96,24.26 18.36,24.26 18.52,24.1 18.52,21.9 18.24,21.62 17.07,21.62 16.79,21.9 16.79,23.09 16.56,23.32 11,23.32 4.24,30.07 4.24,33.27
VBUS on Top Layer: 8.18,21.74 6.73,21.74 6.4,21.41 5.71,21.41 5.39,21.08 5.39,17.61 6.77,16.23 8.15,16.23 8.2,16.28 8.2,16.87 8.15,16.92 6.81,16.92 6.05,17.68 6.05,20.29 6.83,21.08 8.18,21.08 8.2,21.11 8.2,21.72
VBUS on Top Layer: 8.14,21.7 9.05,21.7 10.52,23.16 10.52,28.22 11.33,29.03 12.73,29.03 12.83,28.93 12.83,28.09 12.67,27.94 12.67,24.61 12.85,24.44 14.28,24.44 14.5,24.66 14.5,26.11 14.58,26.19 15.85,26.19 15.98,26.06 15.98,24.66 14.83,23.52 12.37,23.52 9.93,21.08 8.15,21.08 8.03,21.21 8,21.21 8.14,21.35
